# EasyEDA Pro project EP4CE144.eprj

# Schematic EP4CE144

## Sheets
1 Core: Create Date: 2023-07-19; Page Name: Core; Project Name: EP4CE144; Schematic Name: EP4CE144; Update Date: 2023-08-06; Company: 嘉立创EDA; Page Size: A4; Version: V1.0
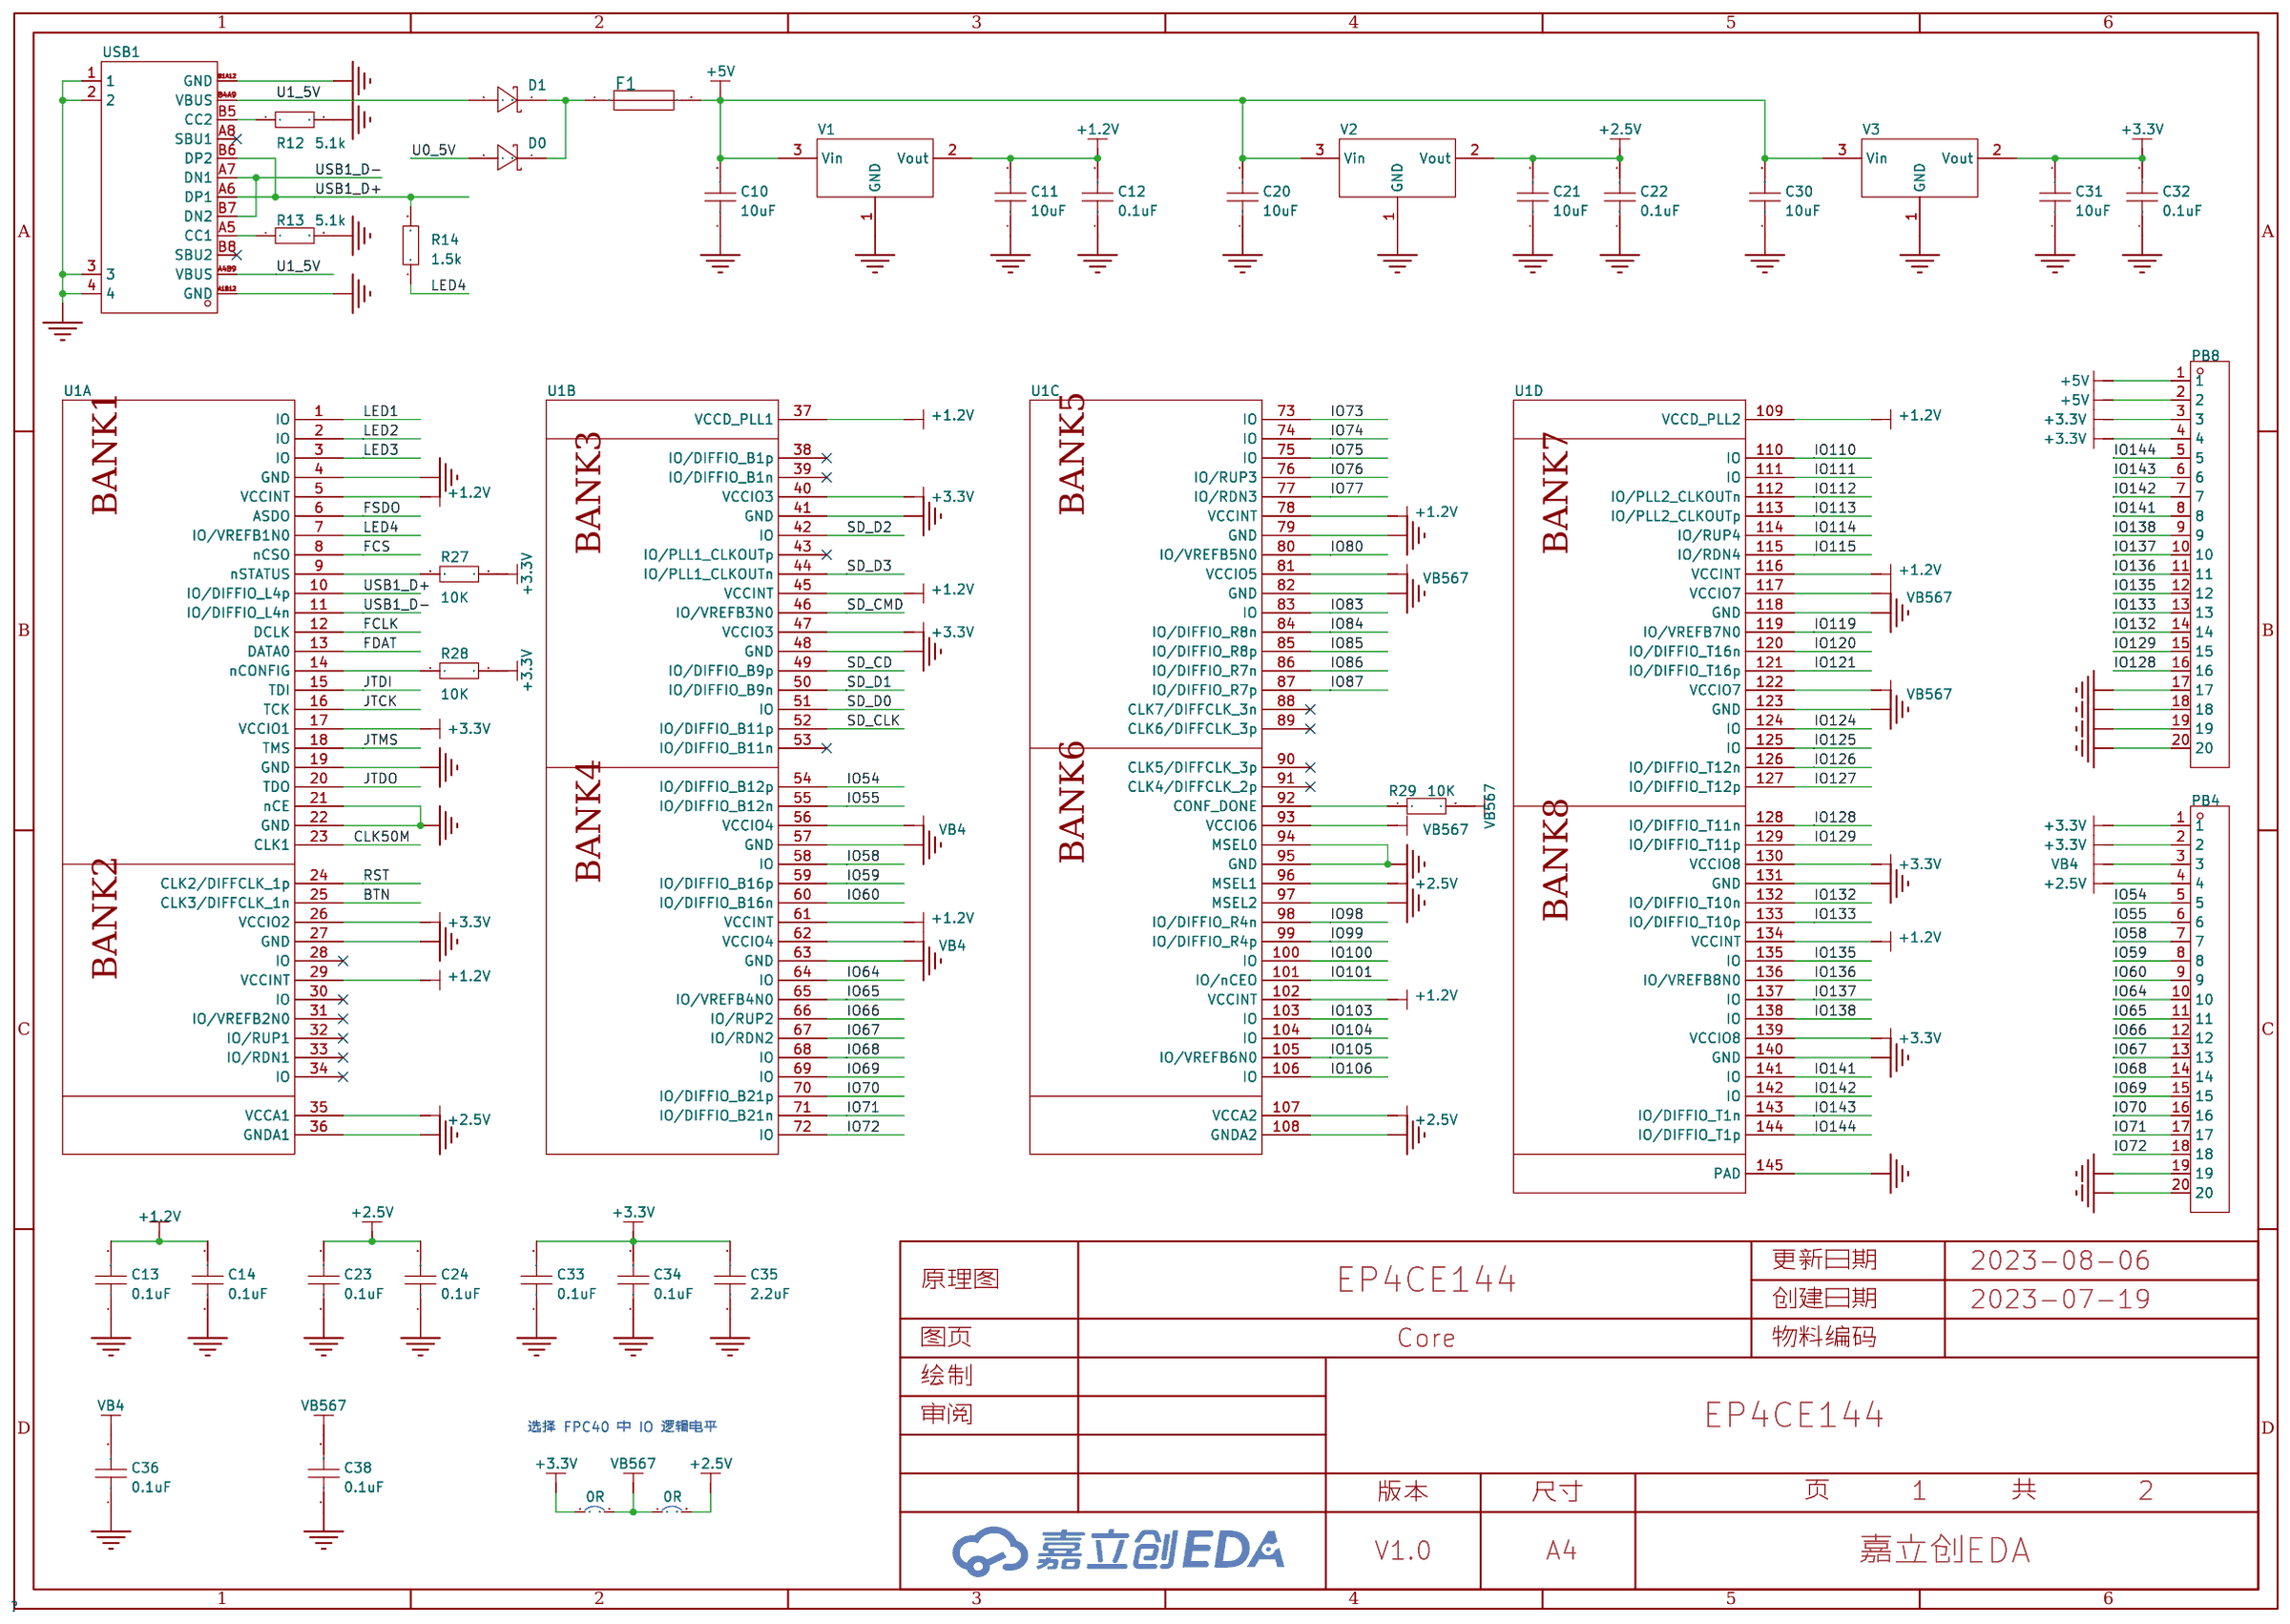
[diagram p0: Core]
2 Other: Create Date: 2023-07-20; Page Name: Other
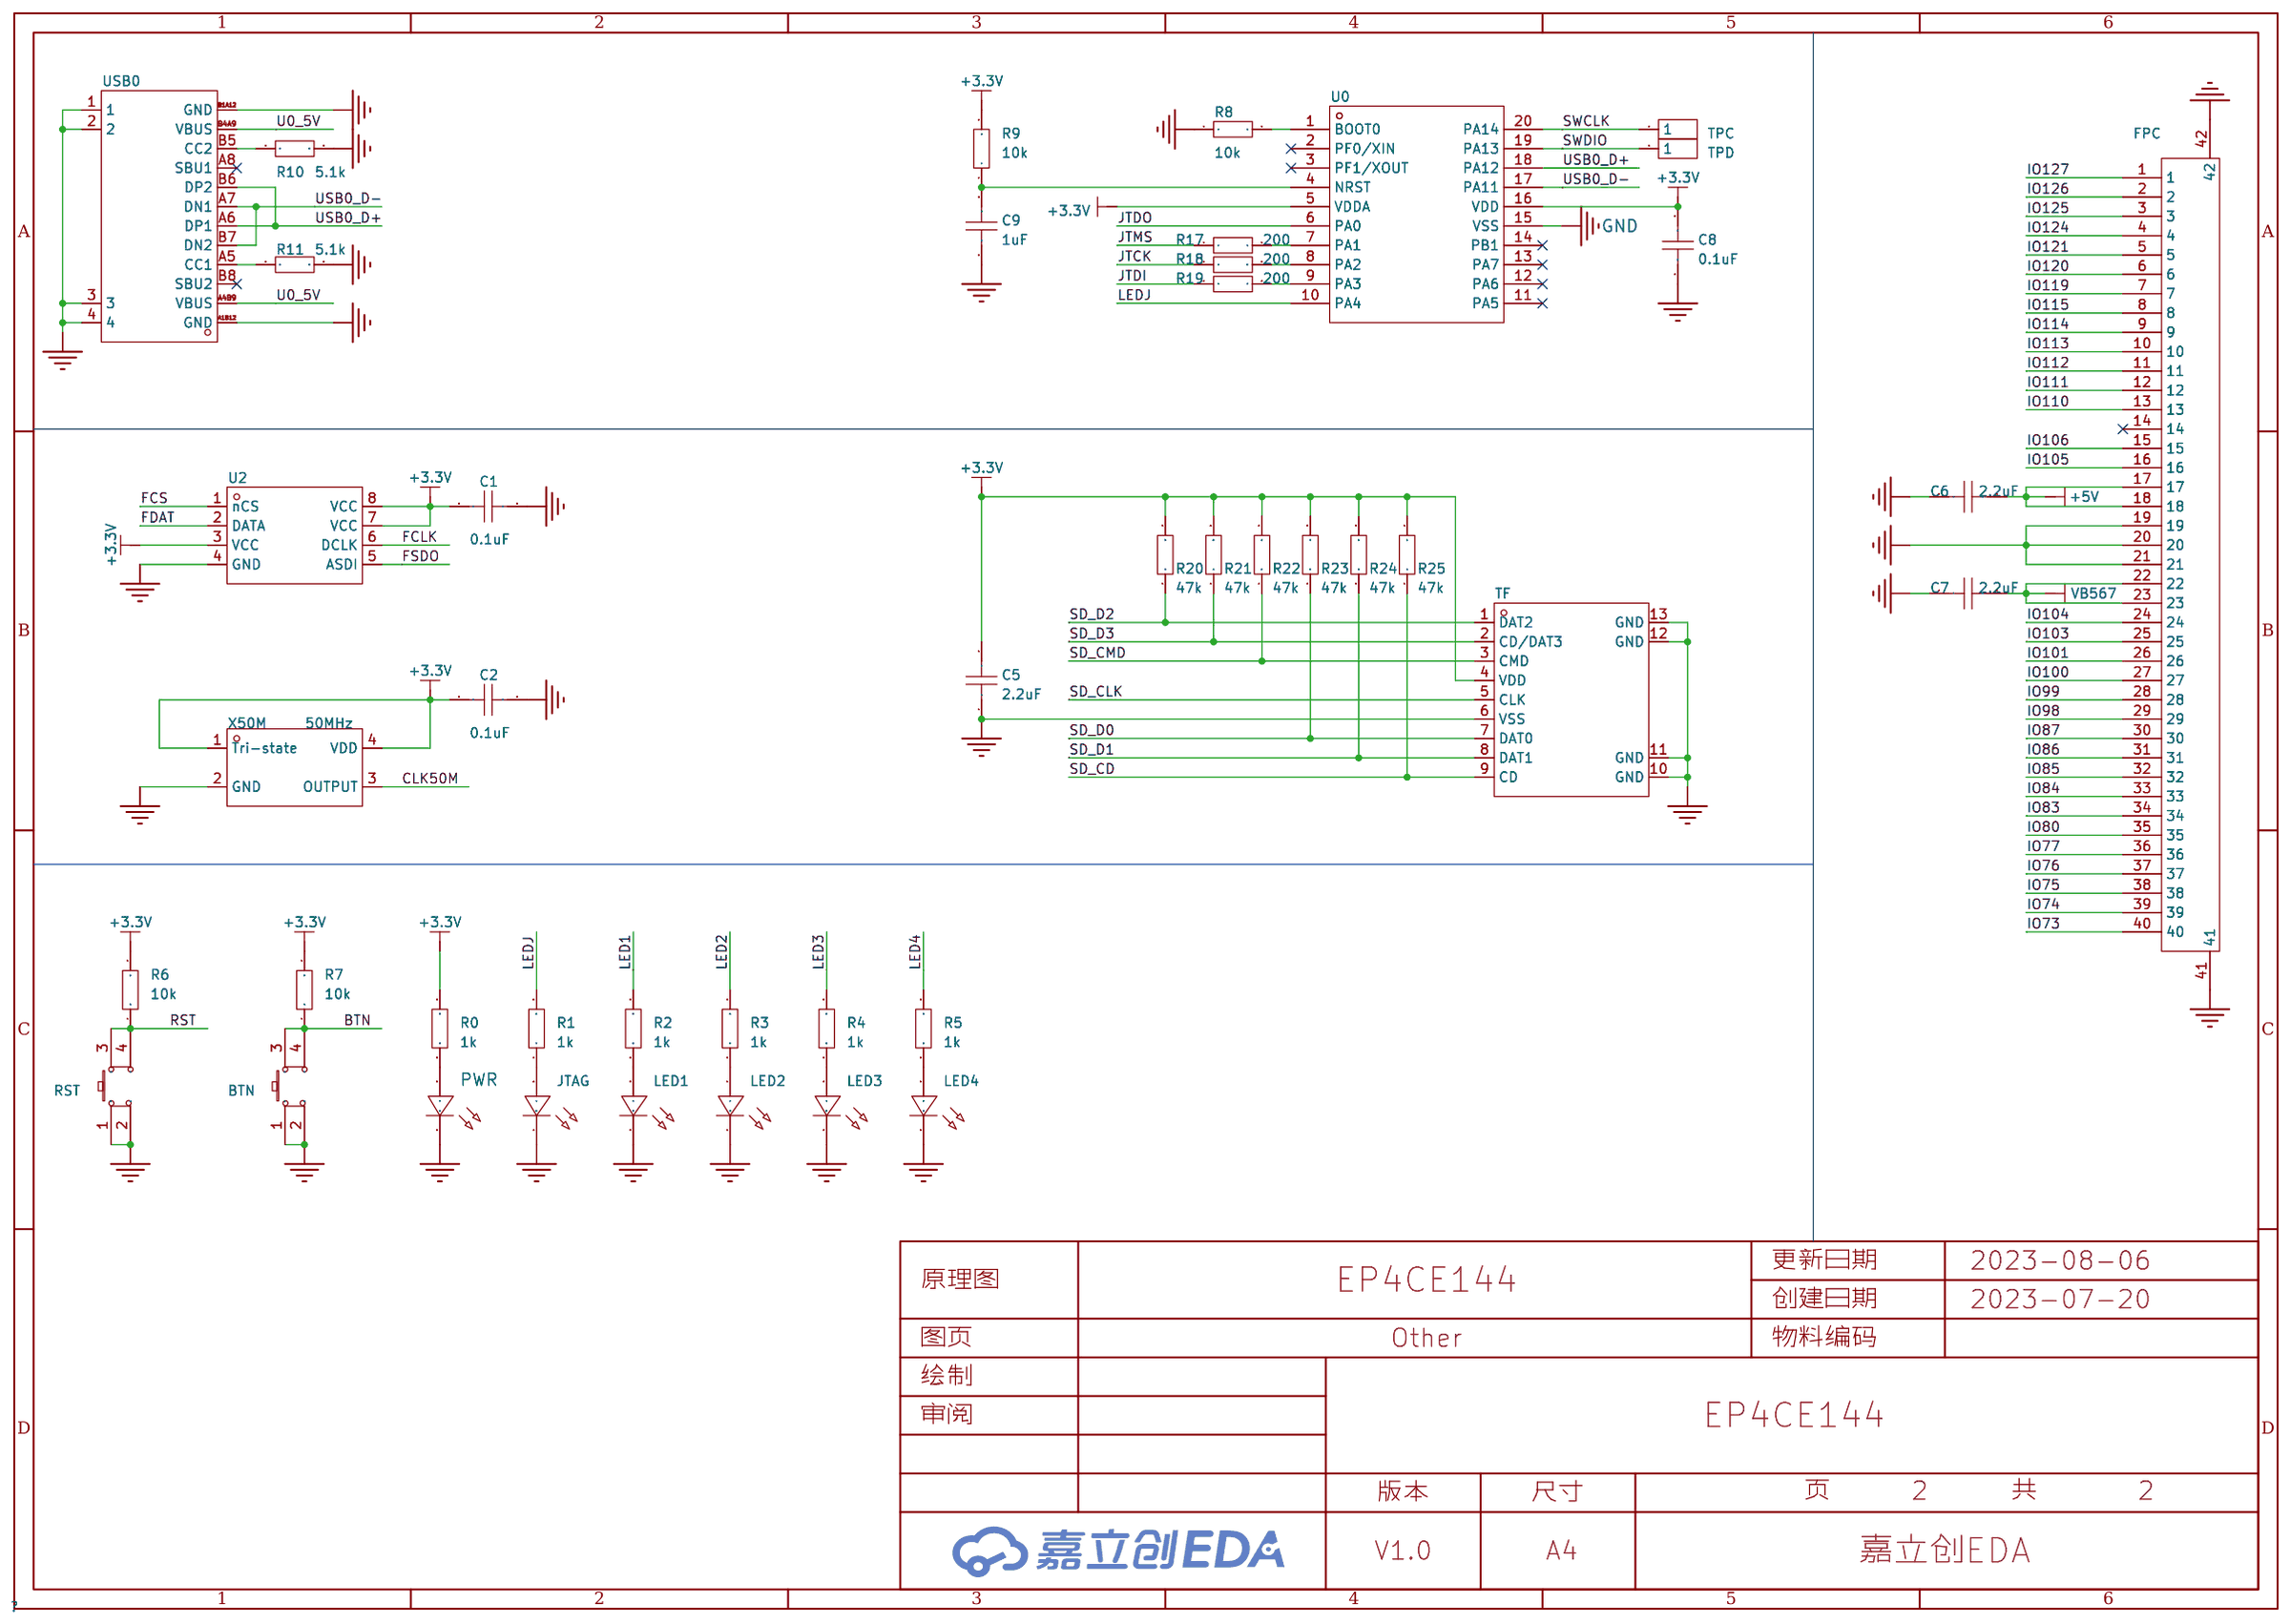
[diagram p1: Other]

## Parts
sheet Core
C10  10uF  [C0603]
C11  10uF  [C0603]
C12  0.1uF  [C0603]
C13  0.1uF  [C0603]
C14  0.1uF  [C0603]
C20  10uF  [C0603]
C21  10uF  [C0603]
C22  0.1uF  [C0603]
C23  0.1uF  [C0603]
C24  0.1uF  [C0603]
C30  10uF  [C0603]
C31  10uF  [C0603]
C32  0.1uF  [C0603]
C33  0.1uF  [C0603]
C34  0.1uF  [C0603]
C35  2.2uF  [C0603]
C36  0.1uF  [C0603]
C38  0.1uF  [C0603]
D0  1N5818W  [SOD-123FL_L2.8-W1.8-LS3.7-RD]
D1  1N5818W  [SOD-123FL_L2.8-W1.8-LS3.7-RD]
F1  JK-nSMD050-30  [F1206]
J1  0R  [R0603]
J2  0R  [R0603]
PB4  -  [HDR-TH_20P-P2.54-V-M-1]
PB8  -  [HDR-TH_20P-P2.54-V-M-1]
R12  5.1k  [R0603]
R13  5.1k  [R0603]
R14  1.5k  [R0603]
R27  10K  [R0603]
R28  10K  [R0603]
R29  10K  [R0603]
U1  -  [EQFP-144_L20.0-W20.0-P0.50-LS22.0-TL-EP6.7]  (sections 1L,2B,3R,4T)
USB1  USB-TYPE-C-017  [USB-TYPE-C-SMD_C9900008089]
V1  AMS1117-1.2 SOT-89  [SOT-89-3_L4.5-W2.5-P1.50-LS4.2-BR]
V2  AMS1117-2.5 SOT-89  [SOT-89-3_L4.5-W2.5-P1.50-LS4.2-BR]
V3  AMS1117-3.3  [SOT-89-3_L4.5-W2.5-P1.50-LS4.2-BR]
sheet Other
BTN  PTS815SJK250SMTRLFS  [SW-SMD_4P-L4.2-W3.3-P2.15-LS5.1]
C1  0.1uF  [C0603]
C2  0.1uF  [C0603]
C5  2.2uF  [C0603]
C6  2.2uF  [C0603]
C7  2.2uF  [C0603]
C8  0.1uF  [C0603]
C9  1uF  [C0603]
FPC  AFC01-S40FCA-00  [FPC-SMD_P0.50-40P_FGS-XJ-H2.0]
JTAG  -  [LED0603-RD]
LED1  -  [LED0603-RD_BLUE]
LED2  -  [LED0603-RD_BLUE]
LED3  -  [LED0603-RD_BLUE]
LED4  -  [LED0603-RD_BLUE]
PWR  -  [LED0603-RD_BLUE]
R0  1k  [R0603]
R1  1k  [R0603]
R2  1k  [R0603]
R3  1k  [R0603]
R4  1k  [R0603]
R5  1k  [R0603]
R6  10k  [R0603]
R7  10k  [R0603]
R8  10k  [R0603]
R9  10k  [R0603]
R10  5.1k  [R0603]
R11  5.1k  [R0603]
R17  200  [R0603]
R18  200  [R0603]
R19  200  [R0603]
R20  47k  [R0603]
R21  47k  [R0603]
R22  47k  [R0603]
R23  47k  [R0603]
R24  47k  [R0603]
R25  47k  [R0603]
RST  PTS815SJK250SMTRLFS  [SW-SMD_4P-L4.2-W3.3-P2.15-LS5.1]
TF  TF-01  [TF-SMD_TF-02]
TPC  -  [TP]
TPD  -  [TP]
U0  -  [TSSOP-20_L6.5-W4.4-P0.65-LS6.4-BL]
U2  EPCS16  [SOIC-8_L4.9-W3.9-P1.27-LS6.0-BL]
USB0  USB-TYPE-C-017  [USB-TYPE-C-SMD_C9900008089]
X50M  50MHz  [OSC-SMD_4P-L3.2-W2.5-BL]

## Library data of the parts
C1 C2 C5-C14 C20-C24 C30-C36 C38 = CAP_0603: 容值:100nF;精度:±10%;额定电压:50V;温度系数:X7R;; Supplier Footprint: 0603
D0 D1 = 1N5818W: 二极管配置:独立式;直流反向耐压(Vr):30V;平均整流电流(Io):1A;正向压降(Vf):875mV@3A;反向电流(Ir):1mA@30V;; LCSC Part Name: 30V 1A 875mV@3A; Supplier Part: C437955; Manufacturer: 晶导微电子; Supplier Footprint: SOD-123FL; JLCPCB Part Class: 扩展库; Datasheet: https://atta.szlcsc.com/upload/public/pdf/source/20191021/C437955_D85247C8F9BBF53ADBACE43A150B0393.pdf; Supplier: LCSC; Diode Configuration: 独立式; Reverse Voltage (Vr): 30V; Average Rectified Current (Io): 1A; Forward Voltage (Vf@If): 875mV@3A; Reverse Leakage Current (Ir): 1mA@30V
F1 = JK-nSMD050-30: 最大电压:30V;最大电流:100A;保持电流:500mA;跳闸电流:1A;; LCSC Part Name: 30V 500mA 1206自恢复; Supplier Part: C720075; Manufacturer: JK(金科); Supplier Footprint: 1206; JLCPCB Part Class: 扩展库; Datasheet: https://atta.szlcsc.com/upload/public/pdf/source/20200810/C720075_06AF2D4541537091880CC35F0EFB49F8.pdf; Supplier: LCSC; Operating Voltage (Max): 30V; Current Rating (Max): 100A; Hold Current: 500mA; Trip Current: 1A; Power Dissipation: 600mW; Resistance - Initial (Ri) (Min): 150mΩ; Resistance - Post Trip (R1) (Max): 300mΩ; Maximum Time to Trip: 100ms; Operating Temperature: -40℃~+85℃
J1 J2 = jumper
PB4 PB8 = HDR-M_2.54_1x20P: 间距:2.54mm;总PIN位数:20;排数:1;插针结构:-;行距:-;安装类型:直插;圆针/方针:-;额定电流:-;额定电压:-;配合针长度:-;塑高:-;触头材质:黄铜;触头镀层:-;颜色:黑色;; Supplier Part: C50981; Supplier Footprint: 插件
R0-R14 R17-R25 R27-R29 = Res_0603: Supplier Footprint: 0603
U1 = EP4CE10E22
USB0 USB1 = USB-TYPE-C-017: 连接器类型:Type-C;标准:-;公母:母座;触点数量:16;端口数量:1;安装方式:卧贴;额定电流 - 电源:3A;工作温度范围:-25~+85;; Supplier Part: C2927037; Manufacturer: DEALON(德艺隆); Supplier Footprint: SMD; JLCPCB Part Class: 扩展库; Datasheet: https://atta.szlcsc.com/upload/public/pdf/source/20211217/653222EE5174722C9DFE2966329956D8.pdf; Supplier: LCSC; Connector Type: Type-C; Gender: 母座; Number of Contacts: 16; Number of Ports: 1; Mounting Style: 卧贴; Current Rating - Power (Max): 3A; Operating Temperature Range: -25~+85
V1 = AMS1117-1.2_SOT-89: 输出类型:-;; Supplier Part: C2690335; Manufacturer: Slkor(萨科微); Supplier Footprint: SOT-89; JLCPCB Part Class: 扩展库; Datasheet: https://atta.szlcsc.com/upload/public/pdf/source/20201231/C426566_7F22DB93439D00F3FA27143E4F28C6AA.pdf; Supplier: LCSC
V2 = AMS1117-2.5_SOT-89: 输出类型:-;; Supplier Part: C2690336; Manufacturer: Slkor(萨科微); Supplier Footprint: SOT-89-3; JLCPCB Part Class: 扩展库; Datasheet: https://atta.szlcsc.com/upload/public/pdf/source/20201231/C426566_7F22DB93439D00F3FA27143E4F28C6AA.pdf; Supplier: LCSC
V3 = AMS1117-3.3_SOT-89: 输出类型:-;; Supplier Part: C880752; Manufacturer: Slkor(萨科微); Supplier Footprint: SOT-89-3; JLCPCB Part Class: 扩展库; Datasheet: https://atta.szlcsc.com/upload/public/pdf/source/20201231/C426566_7F22DB93439D00F3FA27143E4F28C6AA.pdf; Supplier: LCSC
BTN RST = PTS815SJK250SMTRLFS: 操作寿命10万次，使用温度-20°C 至 70°C,尺寸4.20mmx3.20mmx2.50mm，操作力度2.5N; LCSC Part Name: 轻触开关; Supplier Part: C918859; Manufacturer: C&K; Supplier Footprint: SMD; JLCPCB Part Class: 扩展库; Datasheet: https://atta.szlcsc.com/upload/public/pdf/source/20190916/C411883_4F77F16E1D8E48DC707D8949CEE7CF80.pdf; Supplier: LCSC
FPC = AFC01-S40FCA-00: 间距:0.5mm;触点数量:40;锁定特性:翻盖式;安装类型:卧贴;触点类型:下接;; LCSC Part Name: FPC 0.5MM 40P 翻盖式 H2.0mm 下接; Supplier Part: C262674; Manufacturer: JS(钜硕电子); Supplier Footprint: P=0.5mm; JLCPCB Part Class: 扩展库; Datasheet: https://atta.szlcsc.com/upload/public/pdf/source/20180814/C262674_1AF28B4A53C394BA00EA1A6141614455.pdf; Supplier: LCSC; Pitch: 0.5mm; Number of Contacts: 40; Locking Feature: 翻盖式; Mounting Type: 卧贴; Contact Type: 下接; Height Above Board: 2mm; FFC, FCB Thickness: 0.3mm~0.3mm
JTAG = LED_0603-G: 照明颜色:翠绿;色温 - CCT（K）:-;主波长/色坐标:520~535nm;; Supplier Footprint: 0603; Supplier Part: C72043
LED1-LED4 = LED_0603-B: 照明颜色:蓝色;主波长/色坐标:465~475nm;; Supplier Footprint: 0603; Supplier Part: C72041
PWR = LED_0603-R: 发光颜色:红灯;二极管配置:-;透镜颜色:无色透明;主波长:617.5nm;峰值波长:632nm;色温:-;光通量(25℃时):-;测试电流:5mA;正向电压(VF):2.2V;发光强度:28.5mcd;功率:60mW;发光角度:120°;安装方式:-;工作温度:-40℃~+85℃;; Supplier Footprint: 0603; Supplier Part: C72044
TF = TF-01: 卡连接方式:自弹式;卡类型:MicroSD卡(TF卡);连接器类型:卡座;本体最大高度:2mm;工作温度范围:-;; LCSC Part Name: 自弹式 MicroSD卡(TF卡) 卡座 9P外焊 端子镀金; Supplier Part: C2889257; Manufacturer: Yuandi(台湾元迪); Supplier Footprint: SMD; JLCPCB Part Class: 扩展库; Datasheet: https://atta.szlcsc.com/upload/public/pdf/source/20210830/04E8B8B371F2BAAE2FD01F5A99E06D9E.pdf; Supplier: LCSC; Card Connection Mode: 自弹式; Card Type: MicroSD卡(TF卡); Connector Type: 卡座; Maximum Body Height: 2mm
TPC TPD = TP
U0 = AT32F425F8
U2 = EPCS16: Supplier Part: C9900013319; Supplier Footprint: SOIC8-150MIL; JLCPCB Part Class: 扩展库; Datasheet: https://atta.szlcsc.comnull; Supplier: LCSC
X50M = OT322550MJBA4SL: 频率:50MHz;频率稳定度:±10ppm;工作电压:1.8V~3.3V;; LCSC Part Name: 50MHz ±10ppm 1.8V~3.3V YSO110TR; Supplier Part: C717684; Manufacturer: YXC(扬兴晶振); Supplier Footprint: SMD3225-4P; JLCPCB Part Class: 扩展库; Datasheet: https://atta.szlcsc.com/upload/public/pdf/source/20210329/C669065_30B18CFE780D377BA4E84F6ED1951959.pdf; Supplier: LCSC; Frequency Stability: ±10ppm; Supply Voltage: 1.8V~3.3V; Operating Temperature: -40℃~+85℃

## Nets
+1.2V: C11.2 C12.2 C13.2 C14.2 U1.5(VCCINT) U1.29(VCCINT) U1.37(VCCD_PLL1) U1.45(VCCINT) U1.61(VCCINT) U1.78(VCCINT) U1.102(VCCINT) U1.109(VCCD_PLL2) U1.116(VCCINT) U1.134(VCCINT) V1.2(Vout)
+2.5V: C21.2 C22.2 C23.2 C24.2 J2.2 PB4.4 U1.35(VCCA1) U1.96(MSEL1) U1.107(VCCA2) V2.2(Vout)
+3.3V: C1.2 C2.2 C5.2 C8.2 C31.2 C32.2 C33.2 C34.2 C35.2 J1.1 PB4.1 PB4.2 PB8.3 PB8.4 R0.2 R6.2 R7.2 R9.2 R20.2 R21.2 R22.2 R23.2 R24.2 R25.2 R27.2 R28.2 TF.4(VDD) U0.5(VDDA) U0.16(VDD) U1.17(VCCIO1) U1.26(VCCIO2) U1.40(VCCIO3) U1.47(VCCIO3) U1.130(VCCIO8) U1.139(VCCIO8) U2.3(VCC) U2.7(VCC) U2.8(VCC) V3.2(Vout) X50M.1(Tri-state) X50M.4(VDD)
+5V: C6.2 C10.2 C20.2 C30.2 F1.2 FPC.17 FPC.18 PB8.1 PB8.2 V1.3(Vin) V2.3(Vin) V3.3(Vin)
GND: BTN.1 BTN.2 C1.1 C2.1 C5.1 C6.1 C7.1 C8.1 C9.1 C10.1 C11.1 C12.1 C13.1 C14.1 C20.1 C21.1 C22.1 C23.1 C24.1 C30.1 C31.1 C32.1 C33.1 C34.1 C35.1 C36.1 C38.1 FPC.19 FPC.20 FPC.21 FPC.41 FPC.42 JTAG.1(C) LED1.1(C) LED2.1(C) LED3.1(C) LED4.1(C) PB4.19 PB4.20 PB8.17 PB8.18 PB8.19 PB8.20 PWR.1(C) R8.1 R10.2 R11.2 R12.2 R13.2 RST.1 RST.2 TF.6(VSS) TF.10(GND) TF.11(GND) TF.12(GND) TF.13(GND) U0.15(VSS) U1.4(GND) U1.19(GND) U1.21(nCE) U1.22(GND) U1.27(GND) U1.36(GNDA1) U1.41(GND) U1.48(GND) U1.57(GND) U1.63(GND) U1.79(GND) U1.82(GND) U1.94(MSEL0) U1.95(GND) U1.97(MSEL2) U1.108(GNDA2) U1.118(GND) U1.123(GND) U1.131(GND) U1.140(GND) U1.145(PAD) U2.4(GND) USB0.1 USB0.2 USB0.3 USB0.4 USB0.A1B12(GND) USB0.B1A12(GND) USB1.1 USB1.2 USB1.3 USB1.4 USB1.A1B12(GND) USB1.B1A12(GND) V1.1(GND) V2.1(GND) V3.1(GND) X50M.2(GND)
BTN: BTN.3 BTN.4 R7.1 U1.25(CLK3/DIFFCLK_1n)
CLK50M: U1.23(CLK1) X50M.3(OUTPUT)
FCLK: U1.12(DCLK) U2.6(DCLK)
FCS: U1.8(nCSO) U2.1(nCS)
FDAT: U1.13(DATA0) U2.2(DATA)
FSDO: U1.6(ASDO) U2.5(ASDI)
IO54: PB4.5 U1.54(IO/DIFFIO_B12p)
IO55: PB4.6 U1.55(IO/DIFFIO_B12n)
IO58: PB4.7 U1.58(IO)
IO59: PB4.8 U1.59(IO/DIFFIO_B16p)
IO60: PB4.9 U1.60(IO/DIFFIO_B16n)
IO64: PB4.10 U1.64(IO)
IO65: PB4.11 U1.65(IO/VREFB4N0)
IO66: PB4.12 U1.66(IO/RUP2)
IO67: PB4.13 U1.67(IO/RDN2)
IO68: PB4.14 U1.68(IO)
IO69: PB4.15 U1.69(IO)
IO70: PB4.16 U1.70(IO/DIFFIO_B21p)
IO71: PB4.17 U1.71(IO/DIFFIO_B21n)
IO72: PB4.18 U1.72(IO)
IO73: FPC.40 U1.73(IO)
IO74: FPC.39 U1.74(IO)
IO75: FPC.38 U1.75(IO)
IO76: FPC.37 U1.76(IO/RUP3)
IO77: FPC.36 U1.77(IO/RDN3)
IO80: FPC.35 U1.80(IO/VREFB5N0)
IO83: FPC.34 U1.83(IO)
IO84: FPC.33 U1.84(IO/DIFFIO_R8n)
IO85: FPC.32 U1.85(IO/DIFFIO_R8p)
IO86: FPC.31 U1.86(IO/DIFFIO_R7n)
IO87: FPC.30 U1.87(IO/DIFFIO_R7p)
IO98: FPC.29 U1.98(IO/DIFFIO_R4n)
IO99: FPC.28 U1.99(IO/DIFFIO_R4p)
IO100: FPC.27 U1.100(IO)
IO101: FPC.26 U1.101(IO/nCEO)
IO103: FPC.25 U1.103(IO)
IO104: FPC.24 U1.104(IO)
IO105: FPC.16 U1.105(IO/VREFB6N0)
IO106: FPC.15 U1.106(IO)
IO110: FPC.13 U1.110(IO)
IO111: FPC.12 U1.111(IO)
IO112: FPC.11 U1.112(IO/PLL2_CLKOUTn)
IO113: FPC.10 U1.113(IO/PLL2_CLKOUTp)
IO114: FPC.9 U1.114(IO/RUP4)
IO115: FPC.8 U1.115(IO/RDN4)
IO119: FPC.7 U1.119(IO/VREFB7N0)
IO120: FPC.6 U1.120(IO/DIFFIO_T16n)
IO121: FPC.5 U1.121(IO/DIFFIO_T16p)
IO124: FPC.4 U1.124(IO)
IO125: FPC.3 U1.125(IO)
IO126: FPC.2 U1.126(IO/DIFFIO_T12n)
IO127: FPC.1 U1.127(IO/DIFFIO_T12p)
IO128: PB8.16 U1.128(IO/DIFFIO_T11n)
IO129: PB8.15 U1.129(IO/DIFFIO_T11p)
IO132: PB8.14 U1.132(IO/DIFFIO_T10n)
IO133: PB8.13 U1.133(IO/DIFFIO_T10p)
IO135: PB8.12 U1.135(IO)
IO136: PB8.11 U1.136(IO/VREFB8N0)
IO137: PB8.10 U1.137(IO)
IO138: PB8.9 U1.138(IO)
IO141: PB8.8 U1.141(IO)
IO142: PB8.7 U1.142(IO)
IO143: PB8.6 U1.143(IO/DIFFIO_T1n)
IO144: PB8.5 U1.144(IO/DIFFIO_T1p)
JTCK: R18.1 U1.16(TCK)
JTDI: R19.1 U1.15(TDI)
JTDO: U0.6(PA0) U1.20(TDO)
JTMS: R17.1 U1.18(TMS)
LED1: R2.2 U1.1(IO)
LED2: R3.2 U1.2(IO)
LED3: R4.2 U1.3(IO)
LED4: R5.2 R14.1 U1.7(IO/VREFB1N0)
LEDJ: R1.2 U0.10(PA4)
RST: R6.1 RST.3 RST.4 U1.24(CLK2/DIFFCLK_1p)
SD_CD: R25.1 TF.9(CD) U1.49(IO/DIFFIO_B9p)
SD_CLK: TF.5(CLK) U1.52(IO/DIFFIO_B11p)
SD_CMD: R22.1 TF.3(CMD) U1.46(IO/VREFB3N0)
SD_D0: R23.1 TF.7(DAT0) U1.51(IO)
SD_D1: R24.1 TF.8(DAT1) U1.50(IO/DIFFIO_B9n)
SD_D2: R20.1 TF.1(DAT2) U1.42(IO)
SD_D3: R21.1 TF.2(CD/DAT3) U1.44(IO/PLL1_CLKOUTn)
SWCLK: TPC.1 U0.20(PA14)
SWDIO: TPD.1 U0.19(PA13)
U0_5V: D0.2(A) USB0.A4B9(VBUS) USB0.B4A9(VBUS)
U1_5V: D1.2(A) USB1.A4B9(VBUS) USB1.B4A9(VBUS)
USB0_D+: U0.18(PA12) USB0.A6(DP1) USB0.B6(DP2)
USB0_D-: U0.17(PA11) USB0.A7(DN1) USB0.B7(DN2)
USB1_D+: R14.2 U1.10(IO/DIFFIO_L4p) USB1.A6(DP1) USB1.B6(DP2)
USB1_D-: U1.11(IO/DIFFIO_L4n) USB1.A7(DN1) USB1.B7(DN2)
VB4: C36.2 PB4.3 U1.56(VCCIO4) U1.62(VCCIO4)
VB567: C7.2 C38.2 FPC.22 FPC.23 J1.2 J2.1 R29.2 U1.81(VCCIO5) U1.93(VCCIO6) U1.117(VCCIO7) U1.122(VCCIO7)
$1N9749: R27.1 U1.9(nSTATUS)
$1N9754: R28.1 U1.14(nCONFIG)
$1N9991: R29.1 U1.92(CONF_DONE)
$1N22061: R13.1 USB1.A5(CC1)
$1N22062: R12.1 USB1.B5(CC2)
$1N30391: D0.1(C) D1.1(C) F1.1
$2N2331: R8.2 U0.1(BOOT0)
$2N2337: C9.2 R9.1 U0.4(NRST)
$2N3716: LED3.2(A) R4.1
$2N19061: JTAG.2(A) R1.1
$2N19130: LED1.2(A) R2.1
$2N19202: LED2.2(A) R3.1
$2N19326: LED4.2(A) R5.1
$2N27195: PWR.2(A) R0.1
$2N28548: R17.2 U0.7(PA1)
$2N28577: R18.2 U0.8(PA2)
$2N28606: R19.2 U0.9(PA3)
$2N30524: R11.1 USB0.A5(CC1)
$2N30525: R10.1 USB0.B5(CC2)

Not connected (* = marked no-connect by the designer): FPC 14*; U0 2(PF0/XIN)* 3(PF1/XOUT)* 11(PA5)* 12(PA6)* 13(PA7)* 14(PB1)*; U1 28(IO)* 30(IO)* 31(IO/VREFB2N0)* 32(IO/RUP1)* 33(IO/RDN1)* 34(IO)* 38(IO/DIFFIO_B1p)* 39(IO/DIFFIO_B1n)* 43(IO/PLL1_CLKOUTp)* 53(IO/DIFFIO_B11n)* 88(CLK7/DIFFCLK_3n)* 89(CLK6/DIFFCLK_3p)* 90(CLK5/DIFFCLK_3p)* 91(CLK4/DIFFCLK_2p)*; USB0 A8(SBU1)* B8(SBU2)*; USB1 A8(SBU1)* B8(SBU2)*

## Notes on the sheets
sheet 1
- 选择 FPC40 中 IO 逻辑电平

# Board EP4CE144
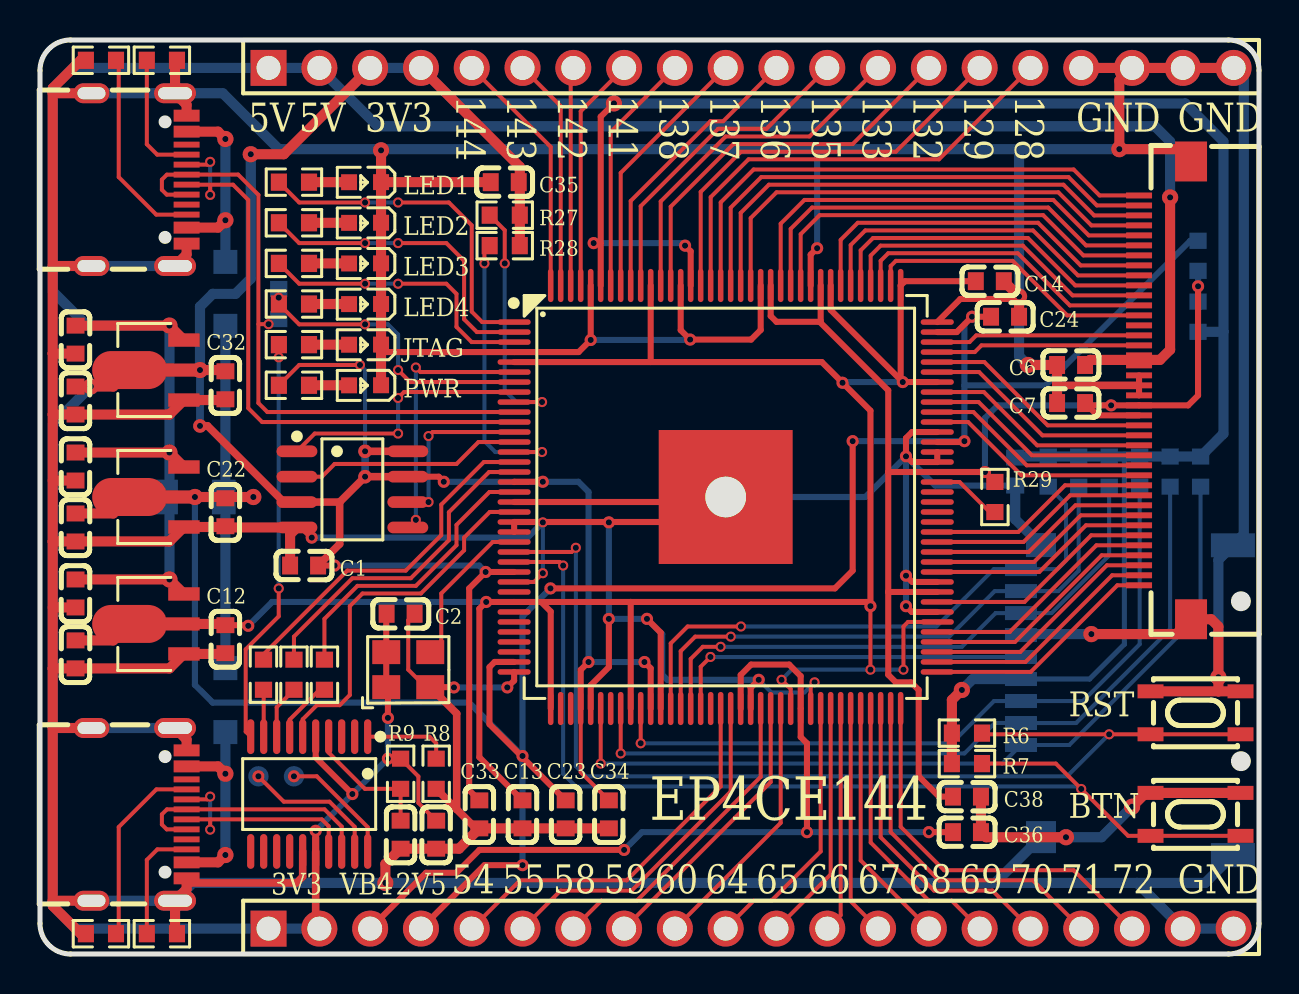
[diagram p2: board, top side]
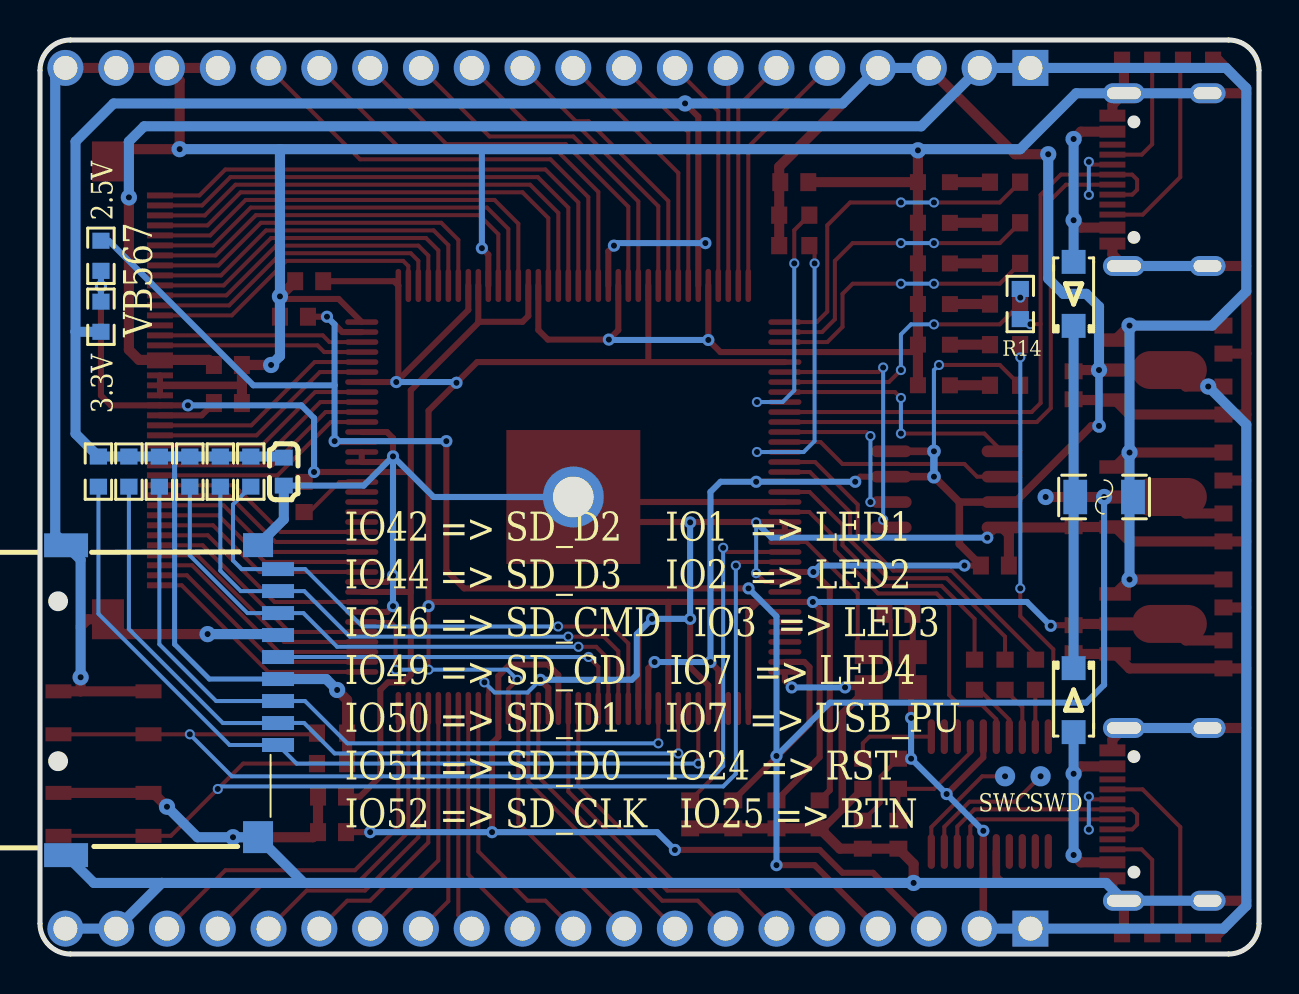
[diagram p3: board, bottom side, seen from below]